# Altium schematic sheet 控制板.SchDoc (part 2 of 2) (continued)
## Nets (continued)
U102-G2: R74.1 U102.G2
U102-G3: R78.2 U102.G3
U102-G4: R432.1 U102.G4
U102-G5: R450.2 U102.G5
U102-G6: R384.2 U101.145(PD3) U102.G6
U102-G11: R517.2 U100.73(PE10) U102.G11
U102-G12: R492.1 U100.88(PH11) U102.G12
U102-G13: R534.1 U100.70(PE9) U102.G13
U102-G14: R516.2 U100.75(PE12) U102.G14
U102-G15: R481.2 U100.110(PG6) U102.G15
U102-G16: R482.2 U100.111(PG7) U102.G16
U102-H1: R73.2 U102.H1
U102-H2: R76.1 U102.H2
U102-H3: R433.1 U102.H3
U102-H4: R434.1 U102.H4
U102-H5: R373.2 U101.163(PB5) U102.H5
U102-H6: R383.1 U101.146(PD4) U102.H6
U102-H11: R493.2 U100.84(PH7) U102.H11
U102-H12: R512.2 U100.78(PE15) U102.H12
U102-H13: R471.2 U100.89(PH12) U102.H13
U102-H14: R507.1 U100.118(PC9) U102.H14
U102-H15: R504.1 U100.115(PC6) U102.H15
U102-H16: R505.1 U100.116(PC7) U102.H16
U102-J1: R72.2 U102.J1
U102-J2: C146.2 R308.2 U102.J2
U102-J4: R378.1 U101.169(PE0) U102.J4
U102-J5: R372.1 U102.J5
U102-J6: R380.1 U101.164(PB6) U102.J6
U102-J11: R160.1 U102.J11
U102-J12: R538.1 U100.69(PE8) U102.J12
U102-J13: R484.1 U102.J13
U102-J14: R487.1 U102.J14
U102-J15: C287.1 R137.2 U102.J15
U102-J16: C286.1 R138.2 U102.J16
U102-K1: R71.2 U102.K1
U102-K2: R420.1 U101.108(PG4) U102.K2
U102-K3: R427.2 U101.111(PG7) U102.K3
U102-K4: C8.1 R35.1 U102.K4
U102-K5: R371.1 U102.K5
U102-K6: R376.2 U101.147(PD5) U102.K6
U102-K11: R470.1 U102.K11
U102-K12: R161.1 U102.K12
U102-K13: R469.1 U102.K13
U102-K14: C305.2 R147.2 U102.K14
U102-K15: C288.1 R136.2 U102.K15
U102-K16: C307.2 R145.2 U102.K16
U102-L1: R418.1 U101.112(PG8) U102.L1
U102-L2: R419.1 U101.110(PG6) U102.L2
U102-L3: R421.1 U101.106(PG2) U102.L3
U102-L4: R428.2 U101.109(PG5) U102.L4
U102-L5: R429.2 U101.107(PG3) U102.L5
U102-L7: C283.2 R116.2 U102.L7
U102-L8: C285.2 R118.2 U102.L8
U102-L9: R515.2 U100.77(PE14) U102.L9
U102-L10: R514.2 U100.74(PE11) U102.L10
U102-L12: C314.2 R157.2 U102.L12
U102-L13: C315.2 R156.2 U102.L13
U102-L14: C306.2 R146.2 U102.L14
U102-L15: C289.1 R135.2 U102.L15
U102-L16: C308.2 R144.2 U102.L16
U102-M1: R70.2 U102.M1
U102-M2: R69.2 U102.M2
U102-M3: C149.2 R318.2 U102.M3
U102-M6: C150.2 R326.1 U102.M6
U102-M7: R393.1 U101.66(PG0) U102.M7
U102-M8: R79.2 U102.M8
U102-M9: R513.2 U100.76(PE13) U102.M9
U102-M10: R475.2 U100.97(PD9) U102.M10
U102-M11: C317.2 R154.2 U102.M11
U102-M14: C316.2 R155.2 U102.M14
U102-M15: C290.1 R134.2 U102.M15
U102-M16: C309.2 R143.2 U102.M16
U102-N1: C261.2 R68.2 U102.N1
U102-N2: R392.1 U101.65(PF15) U102.N2
U102-N3: R527.2 U100.142(PD0) U102.N3
U102-N6: R395.1 U101.75(PE12) U102.N6
U102-N7: R411.2 U101.88(PH11) U102.N7
U102-N8: R530.2 U100.150(PD6) U102.N8
U102-N9: R585.1 U100.165(PB7) U102.N9
U102-N10: R587.2 U100.170(PE1) U102.N10
U102-N14: C318.2 R153.2 U102.N14
U102-N15: C300.2 R133.2 U102.N15
U102-N16: C310.2 R142.2 U102.N16
U102-P1: C262.2 R67.2 U102.P1
U102-P2: R66.2 U102.P2
U102-P4: R394.1 U101.73(PE10) U102.P4
U102-P5: R406.1 U101.83(PH6) U102.P5
U102-P6: C38.1 R124.2 U102.P6
U102-P7: R403.1 U101.77(PE14) U102.P7
U102-P8: R398.2 U101.67(PG1) U102.P8
U102-P9: C320.2 R151.2 U102.P9
U102-P10: R528.1 U100.145(PD3) U102.P10
U102-P11: R579.1 U100.164(PB6) U102.P11
U102-P12: R531.2 U100.151(PD7) U102.P12
U102-P13: R128.2 U102.P13
U102-P15: C301.2 R132.2 U102.P15
U102-P16: C311.2 R141.2 U102.P16
U102-R1: R65.2 U102.R1
U102-R3: R399.2 U101.69(PE8) U102.R3
U102-R4: R410.1 U101.84(PH7) U102.R4
U102-R5: R397.2 U101.64(PF14) U102.R5
U102-R6: R401.1 U101.76(PE13) U102.R6
U102-R7: R402.1 U101.74(PE11) U102.R7
U102-R8: C319.2 R152.2 U102.R8
U102-R9: R586.2 U100.169(PE0) U102.R9
U102-R10: R532.2 U100.152(PG9) U102.R10
U102-R11: R533.2 U100.146(PD4) U102.R11
U102-R12: R127.2 U102.R12
U102-R13: C321.2 R150.2 U102.R13
U102-R14: C303.2 R130.2 U102.R14
U102-R16: C313.2 R139.2 U102.R16
U102-T2: C35.1 R453.2 U102.T2
U102-T3: R400.2 U101.70(PE9) U102.T3
U102-T4: C36.1 R121.2 U102.T4
U102-T5: C37.1 R122.2 U102.T5
U102-T6: R123.2 U102.T6
U102-T7: C312.2 R140.2 U102.T7
U102-T8: R412.2 U101.87(PH10) U102.T8
U102-T9: R159.1 U102.T9
U102-T10: R125.2 U100.163(PB5) U102.T10
U102-T12: R529.2 U100.147(PD5) U102.T12
U102-T13: R526.2 U100.143(PD1) U102.T13
U102-T14: R149.2 U102.T14
U102-T15: C304.2 R129.2 U102.T15
Y7-Y0.: C395.1 R183.1 U7.13(Y0)
NetC1_1: C1.1 R2.1 R4.1
NetC1_2: C1.2 R1.2 R3.2
NetC2_1: C2.1 R8.1 R10.1
NetC2_2: C2.2 R7.2 R9.2
NetC3_1: C3.1 R14.2 R15.2
NetC3_2: C3.2 R17.1 R18.1
NetC4_2: C4.2 R280.1 R281.1 U300.3(IN+)
NetC6_2: C6.2 Q15.1(B) R266.1 R267.1
NetC7_2: C7.2 Q14.1(B) R294.2 R295.2
NetC9_2: C9.2 J6.4 R41.1 R42.1 R43.1 TP1121.1
NetC10_1: C10.1 R37.2 R39.2 R40.2 TP214.1 U50.7(IN+)
NetC16_2: C16.2 C17.1 C18.1 C20.1 LB4.1 U101.39(VDDA)
NetC21_1: C21.1 C22.1 R23.1 U101.31(NRST)
NetC23_2: C23.2 C24.2 C25.2 LB6.2 OSC2.4(VCC)
NetC28_2: C28.2 R345.1 U25.6(SCL)
NetC29_2: C29.2 R344.1 U25.5(SDA)
NetC40_1: C40.1 C41.2 C42.2 LB1.1 OSC1.4(VCC)
NetC51_2: C51.2 C52.1 C53.2 C54.2 LB2.2 U100.39(VDDA)
NetC61_1: C61.1 Q28B.3 R186.2 R188.2 R606.1
NetC62_1: C62.1 D48.3 R192.1 R193.1 R194.1
NetC65_2: C65.2 D61.3 R195.1 R196.1 R197.1
NetC66_1: C66.1 D52.3 R198.1 R199.1 R200.1
NetC67_2: C67.2 D68.3 R189.2 R190.2 R191.2
NetC68_1: C68.1 Q1B.1(B) R19.1 R20.1
NetC100_2: C100.2 C102.1 R250.2 R256.2 R257.1 U306.3(IN+)
NetC105_1: C105.1 R16.2 R17.2
NetC105_2: C105.2 R13.1 R14.1
NetC106_1: C106.1 C107.1 R13.2 TP281.1 U300.6(IN-)
NetC106_2: C106.2 C107.2 R28.2 R632.1 TP319.1 U300.7(OUT)
NetC108_1: C108.1 C109.1 R16.1 TP282.1 U300.5(IN+)
NetC112_1: C112.1 C113.1 R181.2 R365.1 TP317.1 U300.8(OUT)
NetC112_2: C112.2 C113.2 R5.2 TP277.1 U300.9(IN-)
NetC114_1: C114.1 C115.1 R6.1 TP278.1 U300.10(IN+)
NetC117_1: C117.1 C118.1 R11.2 TP280.1 U300.12(IN+)
NetC119_1: C119.1 C120.1 R184.2 R366.2 TP318.1 U300.14(OUT)
NetC119_2: C119.2 C120.2 R12.1 TP279.1 U300.13(IN-)
NetC121_1: C121.1 R4.2 R6.2
NetC121_2: C121.2 R3.1 R5.1
NetC122_1: C122.1 R10.2 R12.2
NetC122_2: C122.2 R9.1 R11.1
NetC123_1: C123.1 NC43.2 R304.2 U12.7(VOUT)
NetC125_1: C125.1 R259.1 R272.2 R274.2 U304.8(OUT)
NetC125_2: C125.2 R274.1 R275.2 U304.9(IN-)
NetC126_1: C126.1 R269.2 R270.1 U304.10(IN+)
NetC128_1: C128.1 R271.1 R272.1 U304.12(IN+)
NetC129_1: C129.1 R286.1 R287.2 U303.9(IN-)
NetC129_2: C129.2 R253.1 R283.2 R286.2 U303.8(OUT)
NetC130_2: C130.2 R278.1 R279.2 U303.10(IN+)
NetC132_2: C132.2 R283.1 R284.1 U303.12(IN+)
NetC134_2: C134.2 C141.2 R288.1 R297.1 R301.2 U303.5(IN+)
NetC136_2: C136.2 R290.1 R291.1 U304.5(IN+)
NetC138_2: C138.2 R292.1 R293.1 U304.3(IN+)
NetC139_1: C139.1 R264.1 R277.1 R290.2 U304.1(OUT)
NetC139_2: C139.2 R276.1 R277.2 U304.2(IN-)
NetC140_1: C140.1 Q13.1(B) R298.2 R299.2
NetC142_1: C142.1 Q2.1(B) R302.2 R303.2
NetC143_2: C143.2 R305.2 R306.2 R307.2 TP213.1 U50.11(IN+)
NetC144_1: C144.1 J6.3 R309.1 R310.1 R311.1 TP1120.1
NetC145_1: C145.1 R312.2 U50.8(IN-)
NetC147_2: C147.2 R313.1 R314.1
NetC148_2: C148.2 R315.1 R320.2
NetC151_2: C151.2 R325.2 U50.4(IN-)
NetC155_2: C155.2 R329.2 U16.3(IN-)
NetC158_2: C158.2 R322.2 U18.3(IN-)
NetC164_1: C164.1 R323.2 U17.3(IN-)
NetC166_1: C166.1 R331.1 R453.1 U16.7(OUT) U17.7(OUT) U18.7(OUT)
NetC172_2: C172.2 C173.2 R333.1 R334.1 TP150.1 U21.2(IN+)
NetC174_2: C174.2 R335.1 U21.3(IN-)
NetC177_2: C177.2 C178.2 R337.1 R338.1 TP151.1 U20.2(IN+)
NetC179_2: C179.2 R339.2 U20.3(IN-)
NetC182_2: C182.2 C183.2 R341.2 R342.2 TP152.1 U19.2(IN+)
NetC184_2: C184.2 R343.1 U19.3(IN-)
NetC197_2: C197.2 U101.125(VCAP_2)
NetC201_1: C201.1 R359.1 U101.33(PC1)
NetC210_2: C210.2 R358.1 U101.32(PC0)
NetC211_2: C211.2 R360.1 U101.34(PC2)
NetC233_1: C233.1 U101.81(VCAP_1)
NetC247_1: C247.1 R456.1 U10.1(~{MR})
NetC248_1: C248.1 R413.1 R414.2 TP8.1 U10.4(PFI)
NetC264_2: C264.2 R120.2 U102.J3
NetC324_1: C324.1 U100.81(VCAP_1)
NetC325_1: C325.1 U100.125(VCAP_2)
NetC329_1: C329.1 C330.1 R553.2 U100.31(NRST)
NetC359_1: C359.1 Q16.1(B) R595.1 R596.1
NetC360_2: C360.2 R576.2 U24.5(SDA)
NetC361_2: C361.2 R563.2 U24.6(SCL)
NetC365_2: C365.2 C367.1 R590.1 R591.1 R592.2 U307.12(IN+)
NetC369_2: C369.2 Q27B.1(B) R593.2 R594.1
NetC373_1: C373.1 R602.2 U2.1(Y4) U2.13(Y0)
NetC374_1: C374.1 R600.1 U2.5(Y5) U2.14(Y1)
NetC375_1: C375.1 R601.1 U2.15(Y2)
NetC376_1: C376.1 R603.2 U2.12(Y3)
NetC381_1: C381.1 Q29B.3 R185.1 R187.2 R607.1
NetC382_1: C382.1 Q11.1(B) R619.1 R620.1
NetC384_1: C384.1 R610.1 R613.1 R614.2 TP1202.1 U203.5(IN+)
NetC385_1: C385.1 C386.2 R611.1 R612.1 TP1203.1 U203.7(IN+)
NetC387_2: C387.2 Q10.1(B) R622.1 R623.1
NetC388_2: C388.2 Q9.1(B) R625.1 R626.1
NetC391_1: C391.1 R179.1 U4.13(Y0)
NetC407_1: C407.1 R635.2 U7.5(Y5)
NetC410_2: C410.2 R644.2 R647.1 U313.10(IN+)
NetC411_2: C411.2 R640.1 R641.1 U313.3(IN+)
NetC412_1: C412.1 R642.2 R643.2 U313.2(IN-)
NetC412_2: C412.2 R185.2 R186.1 R643.1 R644.1 TP1515.1 U313.1(OUT)
NetC413_2: C413.2 R182.2 R645.1
NetC415_2: C415.2 R630.1 R648.1
NetC416_2: C416.2 R183.2 R651.1
NetC417_2: C417.2 R649.2 R654.1 U302.10(IN+)
NetC419_2: C419.2 R650.2 R658.1 U302.12(IN+)
NetC421_1: C421.1 R655.1 R657.2 U302.5(IN+)
NetC422_1: C422.1 R659.1 R663.2 U302.3(IN+)
NetC423_2: C423.2 R629.1 R656.2
NetC424_2: C424.2 R631.1 R662.1
NetC425_1: C425.1 R180.2 R719.2
NetC426_1: C426.1 R655.2 R684.2 R692.2 R756.1 TP1512.1 U321.7(OUT)
NetC426_2: C426.2 R686.2 R692.1 U321.6(IN-)
NetC427_1: C427.1 R191.1 R192.2 R654.2 R693.2 TP1514.1 U321.8(OUT)
NetC427_2: C427.2 R693.1 R694.1 U321.9(IN-)
NetC428_1: C428.1 R687.1 R688.1 U321.5(IN+)
NetC429_2: C429.2 R689.1 R690.1 U321.3(IN+)
NetC430_1: C430.1 R695.1 R696.1 U321.10(IN+)
NetC431_2: C431.2 R697.1 R698.1 U321.12(IN+)
NetC432_1: C432.1 R691.2 R699.1 U321.2(IN-)
NetC432_2: C432.2 R659.2 R668.2 R699.2 R753.2 TP1511.1 U321.1(OUT)
NetC435_1: C435.1 R658.2 R665.1 R700.2 R743.1 TP52.1 U321.14(OUT)
NetC435_2: C435.2 R700.1 R701.1 U321.13(IN-)
NetC436_1: C436.1 R702.2 R703.2 U320.6(IN-)
NetC436_2: C436.2 R703.1 R724.2 R778.2 R801.1 TP1508.1 U320.7(OUT)
NetC437_1: C437.1 R704.2 R705.1 U320.9(IN-)
NetC437_2: C437.2 R197.2 R704.1 R723.2 R777.2 TP1513.1 U320.8(OUT)
NetC438_2: C438.2 R706.2 R707.2 U320.5(IN+)
NetC439_2: C439.2 R713.2 R714.2 U320.10(IN+)
NetC441_1: C441.1 R710.1 R711.1 U320.2(IN-)
NetC441_2: C441.2 R200.2 R711.2 R728.2 R804.2 TP1507.1 U320.1(OUT)
NetC442_2: C442.2 R708.2 R709.2 U320.3(IN+)
NetC443_2: C443.2 R715.2 R716.2 U320.12(IN+)
NetC445_1: C445.1 R712.2 R727.2 R774.1 R794.1 TP1510.1 U320.14(OUT)
NetC445_2: C445.2 R712.1 R717.2 U320.13(IN-)
NetC447_1: C447.1 R718.2 R723.1 U301.10(IN+)
NetC448_1: C448.1 R726.1 R727.1 U301.12(IN+)
NetC449_2: C449.2 R628.1 R729.2
NetC450_1: C450.1 R177.2 R722.2
NetC452_1: C452.1 R724.1 R725.2 U301.5(IN+)
NetC454_1: C454.1 R728.1 R733.1 U301.3(IN+)
NetC455_1: C455.1 R178.2 R732.2
NetC457_2: C457.2 R737.2 R768.1 R769.1 TP505.1 U206.11(IN+)
NetC458_1: C458.1 Q35B.3 R767.1 R778.1 R779.2
NetC459_1: C459.1 R734.2 R771.1 R772.1 TP49.1 U206.9(IN+)
NetC460_2: C460.2 D55.3 R770.2 R773.2 R774.2
NetC461_1: C461.1 Q34B.3 R775.1 R776.1 R777.1
NetC462_1: C462.1 R766.2 R780.1 R782.1 TP47.1 U206.5(IN+)
NetC463_2: C463.2 R763.2 R781.2 R783.2 TP50.1 U206.7(IN+)
NetC464_1: C464.1 C465.1 R664.2 R674.2 TP35.1 U213.9(IN+)
NetC466_1: C466.1 Q30B.3 R665.2 R666.2 R667.2
NetC467_2: C467.2 D65.3 R668.1 R669.1 R670.1
NetC468_1: C468.1 C469.2 R671.2 R675.1 TP36.1 U213.11(IN+)
NetC471_1: C471.1 C473.1 R676.1 R683.2 TP64.1 U213.7(IN+)
NetC472_2: C472.2 C474.2 R677.2 R680.2 TP37.1 U213.5(IN+)
NetC475_2: C475.2 Q31B.3 R678.2 R679.1 R684.1
NetC476_1: C476.1 Q32B.3 R742.2 R743.2 R746.2
NetC478_2: C478.2 R741.1 R744.2 R747.1 TP32.1 U211.5(IN+)
NetC479_1: C479.1 R738.1 R745.1 R748.2 TP33.1 U211.7(IN+)
NetC480_2: C480.2 R749.2 R750.2 R760.2 TP51.1 U211.11(IN+)
NetC481_1: C481.1 D54.3 R751.1 R752.1 R753.1
NetC482_2: C482.2 Q33B.3 R754.2 R755.2 R756.2
NetC483_2: C483.2 R757.2 R761.2 R762.2 TP48.1 U211.9(IN+)
NetC485_1: C485.1 C491.2 R787.2 R793.1 TP59.1 U212.11(IN+)
NetC486_2: C486.2 Q37B.3 R792.1 R794.2 R795.1
NetC487_1: C487.1 C489.1 R791.2 R796.2 TP60.1 U212.5(IN+)
NetC488_2: C488.2 C490.2 R788.2 R797.1 TP61.1 U212.7(IN+)
NetC492_1: C492.1 D60.3 R798.2 R800.2 R801.2
NetC493_2: C493.2 C494.2 R784.2 R799.1 TP58.1 U212.9(IN+)
NetC495_2: C495.2 Q36B.3 R802.1 R803.1 R804.1
NetD3_3: D3.3(C) NC11.2 R59.2 TP26.1
NetD62_1: D62.1 U306.14(OUT)
NetD62_3: D62.3 R258.1 R322.1 R343.2
NetD63_1: D63.1 U306.7(OUT)
NetD63_3: D63.3 R254.1 R329.1 R335.2
NetD64_1: D64.1 U306.8(OUT)
NetD64_3: D64.3 R265.1 R323.1 R339.1
NetD66_2: D66.2 R170.2 TP45.1
NetD67_2: D67.2 R51.1 TP1500.1
NetD69_2: D69.2 R126.1 TP38.1
NetD1500_3: D1500.3(C) R176.1 R555.2
NetD1504_3: D1504.3(C) R558.2 R646.2
NetD1508_3: D1508.3(C) R551.2 R661.2
NetD1510_3: D1510.3(C) R546.1 R652.2
NetD1513_3: D1513.3(C) R552.2 R720.2
NetD1515_3: D1515.3(C) R554.2 R731.2
NetD1534_3: D1534.3(C) R44.1 R365.2
NetD1535_3: D1535.3(C) R47.1 R366.1
NetD1542_3: D1542.3(C) R255.2 R355.2
NetD1543_3: D1543.3(C) R27.2 R38.2
NetD1544_3: D1544.3(C) R24.2 R28.1
NetJ1_6: J1.6 J12.2
NetJ4_1: J4.1 R107.1
NetJ4_2: J4.2 R106.1
NetJ4_3: J4.3 R464.2
NetJ4_4: J4.4 R461.2
NetJ4_13: J4.13 R163.1 TP1125.1
NetJ4_14: J4.14 R162.1 TP1123.1
NetJ4_15: J4.15 R423.1 TP1124.1
NetJ4_16: J4.16 R422.1 TP1122.1
NetJ4_17: J4.17 R171.2
NetJ4_18: J4.18 R113.1
NetJ4_19: J4.19 R465.2
NetJ4_20: J4.20 R114.1
NetJ4_21: J4.21 R466.2
NetJ4_22: J4.22 R119.1 TP6.1
NetJ4_23: J4.23 R116.1
NetJ4_24: J4.24 R115.1
NetJ4_25: J4.25 R118.1 TP4.1
NetJ4_26: J4.26 R117.1
NetJ5_1: J5.1 R90.1 TP12.1
NetJ5_2: J5.2 R442.1
NetJ5_3: J5.3 R91.1
NetJ5_4: J5.4 R443.1 TP17.1
NetJ5_5: J5.5 R92.1
NetJ5_7: J5.7 R93.1 TP9.1
NetJ5_8: J5.8 R445.1
NetJ5_9: J5.9 R95.1
NetJ5_10: J5.10 R446.1
NetJ5_11: J5.11 R97.1
NetJ5_12: J5.12 R447.1 TP13.1
NetJ5_13: J5.13 R98.1
NetJ5_14: J5.14 R448.1
NetJ5_15: J5.15 R99.1 TP10.1
NetJ5_16: J5.16 R449.1
NetJ5_18: J5.18 R100.1
NetJ5_19: J5.19 R101.1
NetJ5_20: J5.20 R459.2
NetJ5_21: J5.21 R102.1
NetJ5_22: J5.22 R460.2 TP7.1
NetJ5_23: J5.23 R103.1
NetJ5_24: J5.24 R462.2
NetJ5_25: J5.25 R105.1 TP5.1
NetJ5_26: J5.26 R463.2
NetJ6_1: J6.1 R433.2
NetJ6_2: J6.2 R432.2 TP40.1
NetJ6_6: J6.6 R64.2 R67.1
NetJ6_7: J6.7 R75.2 TP31.1
NetJ6_8: J6.8 R431.2
NetJ6_9: J6.9 R81.2
NetJ6_10: J6.10 R80.2 TP41.1
NetJ6_11: J6.11 R83.1 TP34.1
NetJ6_12: J6.12 R435.1
NetJ6_13: J6.13 R84.1
NetJ6_14: J6.14 R436.1
NetJ6_15: J6.15 R85.1
NetJ6_16: J6.16 R437.1 TP43.1
NetJ6_19: J6.19 R86.1
NetJ6_20: J6.20 R438.1
NetJ6_21: J6.21 R87.1 TP39.1
NetJ6_22: J6.22 R439.1
NetJ6_23: J6.23 R88.1
NetJ6_24: J6.24 R440.1
NetJ6_25: J6.25 R89.1
NetJ6_26: J6.26 R441.1 TP42.1
NetJ12_3: J12.3 Q12B.3(C) R458.2 TP53.1
NetNC3_1: NC3.1 R580.1 U100.166(BOOT0)
NetNC4_2: NC4.2 U100.161(PB3)
NetNC5_2: NC5.2 R582.1 U100.171(PDR_ON)
NetNC6_1: NC6.1 R540.1 U100.58(PB2)
NetNC7_1: NC7.1 R497.1 U100.85(PH8)
NetNC8_2: NC8.2 R496.1 U100.86(PH9)
NetNC10_1: NC10.1 Q13B.3(C) R468.2 TP25.1
NetNC14_1: NC14.1 U100.138(PA15)
NetNC18_1: NC18.1 NC25.2 U101.134(PI3)
NetNC18_2: NC18.2 U30.5
NetNC19_1: NC19.1 NC24.2 U101.132(PI1)
NetNC19_2: NC19.2 U30.6
NetNC20_1: NC20.1 NC23.2 U101.130(PH15)
NetNC20_2: NC20.2 U30.7
NetNC22_1: NC22.1 NC30.2 U30.1
NetNC26_1: NC26.1 NC27.2 U30.3
NetNC27_1: NC27.1 U101.129(PH14)
NetNC28_1: NC28.1 NC29.1 U101.133(PI2)
NetNC29_2: NC29.2 U30.2
NetNC30_1: NC30.1 U101.131(PI0)
NetNC31_1: NC31.1 R374.2 U101.155(PG12)
NetNC32_1: NC32.1 R375.2 U101.154(PG11)
NetNC33_2: NC33.2 R382.1 U101.152(PG9)
NetNC34_2: NC34.2 R381.1 U101.153(PG10)
NetNC35_1: NC35.1 R390.1 U101.58(PB2)
NetNC39_2: NC39.2 U13.12(IN+)
NetNC40_2: NC40.2 U13.10(IN+)
NetNC41_1: NC41.1 NC42.2 U13.6(IN-)
NetNC41_2: NC41.2 U13.7(OUT)
NetNC43_1: NC43.1 NC61.1 U13.5(IN+)
NetNC44_2: NC44.2 NC45.2 NC46.2 U13.3(IN+)
NetNC47_2: NC47.2 NC48.1 NC49.1 U13.2(IN-)
NetNC49_2: NC49.2 U13.1(OUT)
NetNC51_2: NC51.2 Q38B.3(C) R444.1 TP54.1
NetNC58_2: NC58.2 R369.2 U101.171(PDR_ON)
NetNC62_2: NC62.2 R58.1 U101.166(BOOT0)
NetNC63_1: NC63.1 U101.121(PA10)
NetNC64_2: NC64.2 NC65.1 U101.119(PA8)
NetNC68_1: NC68.1 R53.2 U101.86(PH9)
NetNC69_1: NC69.1 R52.2 U101.85(PH8)
NetOSC1_3: OSC1.3(OUT) R158.2 R159.2
NetOSC2_3: OSC2.3(OUT) R22.2
NetQ1B_3: Q1B.3(C) R256.1
NetQ2_3: Q2.3(C) R301.1
NetQ4B_3: Q4B.3(C) R25.2 R273.1
NetQ7B_3: Q7B.3(C) R285.1 R364.2
NetQ9B_3: Q9B.3(C) R289.1 R368.2
NetQ10B_3: Q10B.3(C) R396.1 R685.2
NetQ14B_3: Q14B.3(C) R544.1 R660.2
NetQ16B_3: Q16B.3(C) R547.1 R653.2
NetQ17B_3: Q17B.3(C) R548.1 R730.2
NetQ18B_3: Q18B.3(C) R549.1 R721.2
NetQ27B_3: Q27B.3(C) R591.2
NetR20_2: R20.2 R74.2
NetR22_1: R22.1 U101.29(PH0)
NetR30_2: R30.2 U101.7(PI8)
NetR31_1: R31.1 R128.1 R521.1
NetR32_1: R32.1 R123.1 R524.1
NetR33_1: R33.1 R127.1 R489.1
NetR34_1: R34.1 R124.1 R491.1
NetR35_2: R35.2 R36.1 R37.1 U50.1(OUT)
NetR38_1: R38.1 R324.2 TP18.1 U303.6(IN-) U303.7(OUT)
NetR43_2: R43.2 U50.6(IN-)
NetR51_2: R51.2 R391.1 U101.63(PF13)
NetR54_2: R54.2 R267.2
NetR57_2: R57.2 R295.1
NetR62_1: R62.1 R519.2
NetR63_1: R63.1 R520.2
NetR63_2: R63.2 R386.2 U101.139(PC10)
NetR65_1: R65.1 R404.2 U101.79(PB10)
NetR66_1: R66.1 R452.1 U101.105(PD15)
NetR68_1: R68.1 R340.1 R341.1 U19.7(OUT)
NetR69_1: R69.1 R405.1 U101.80(PB11)
NetR70_1: R70.1 R426.2 U101.115(PC6)
NetR71_1: R71.1 R451.2 U101.104(PD14)
NetR72_1: R72.1 R409.1 U101.94(PB14)
NetR73_1: R73.1 R408.1 U101.95(PB15)
NetR76_2: R76.2 R302.1
NetR77_1: R77.1 R417.1 U101.116(PC7)
NetR78_1: R78.1 R425.2 U101.117(PC8)
NetR79_1: R79.1 R416.1 U101.118(PC9)
NetR82_2: R82.2 U101.128(PH13)
NetR104_2: R104.2 U102.A13
NetR108_1: R108.1 R109.1 U100.79(PB10)
NetR110_1: R110.1 R111.1 U100.80(PB11)
NetR121_1: R121.1 R332.2 R333.2 U21.7(OUT)
NetR122_1: R122.1 R336.2 R337.2 U20.7(OUT)
NetR126_2: R126.2 U102.T11
NetR129_1: R129.1 R609.1 R613.2 U203.2(OUT)
NetR130_1: R130.1 R673.1 R674.1 U213.14(OUT)
NetR131_1: R131.1 R682.1 R683.1 U213.1(OUT)
NetR132_1: R132.1 R790.1 R791.1 U212.2(OUT)
NetR133_1: R133.1 R738.2 R739.2 U211.1(OUT)
NetR134_1: R134.1 R736.1 R737.1 U206.13(OUT)
NetR135_1: R135.1 R763.1 R764.1 U206.1(OUT)
NetR136_1: R136.1 R765.1 R766.1 U206.2(OUT)
NetR139_1: R139.1 R680.1 R681.1 U213.2(OUT)
NetR140_1: R140.1 R784.1 R785.1 U212.14(OUT)
NetR141_1: R141.1 R757.1 R758.1 U211.14(OUT)
NetR142_1: R142.1 R734.1 R735.1 U206.14(OUT)
NetR149_1: R149.1 R593.1
NetR150_1: R150.1 R608.1 R612.2 U203.1(OUT)
NetR151_1: R151.1 R671.1 R672.1 U213.13(OUT)
NetR152_1: R152.1 R786.1 R787.1 U212.13(OUT)
NetR153_1: R153.1 R788.1 R789.1 U212.1(OUT)
NetR154_1: R154.1 R740.2 R741.2 U211.2(OUT)
NetR155_1: R155.1 R759.1 R760.1 U211.13(OUT)
NetR158_1: R158.1 U100.29(PH0)
NetR160_2: R160.2 R499.1 U100.95(PB15)
NetR161_2: R161.2 R473.2 U100.94(PB14)
NetR169_1: R169.1 R170.1 U100.155(PG12)
NetR172_1: R172.1 R626.2
NetR175_2: R175.2 R620.2
NetR176_2: R176.2 U307.1(OUT) U307.2(IN-)
NetR187_1: R187.1 U203.6(IN-)
NetR188_1: R188.1 U203.4(IN-)
NetR189_1: R189.1 U213.4(IN-)
NetR194_2: R194.2 U211.4(IN-)
NetR195_2: R195.2 U212.4(IN-)
NetR198_2: R198.2 U206.4(IN-)
NetR251_2: R251.2 U306.5(IN+)
NetR252_2: R252.2 R253.2 R254.2 U306.6(IN-)
NetR258_2: R258.2 R259.2 R260.2 U306.13(IN-)
NetR261_2: R261.2 U306.12(IN+)
NetR262_2: R262.2 U306.10(IN+)
NetR263_2: R263.2 R264.2 R265.2 U306.9(IN-)
NetR273_2: R273.2 U304.13(IN-) U304.14(OUT)
NetR282_1: R282.1 U300.1(OUT)
NetR285_2: R285.2 U303.13(IN-) U303.14(OUT)
NetR289_2: R289.2 U304.6(IN-) U304.7(OUT)
NetR299_1: R299.1 R347.2
NetR307_1: R307.1 R308.1 R316.2 U50.13(OUT)
NetR309_2: R309.2 U50.10(IN-)
NetR313_2: R313.2 R319.2 U50.9(IN+)
NetR317_1: R317.1 R318.1 R319.1 U50.14(OUT)
NetR320_1: R320.1 R327.1 U50.5(IN+)
NetR321_1: R321.1 U303.3(IN+)
NetR326_2: R326.2 R327.2 R328.2 U50.2(OUT)
NetR344_2: R344.2 R353.1 U101.16(PF0)
NetR345_2: R345.2 R389.1 U101.17(PF1)
NetR346_1: R346.1 U25.7(~{WC})
NetR346_2: R346.2 R354.1 U101.18(PF2)
NetR352_1: R352.1 U101.9(PC14)
NetR367_1: R367.1 U101.48(BYPASS_REG)
NetR370_2: R370.2 R371.2 U101.168(PB9)
NetR372_2: R372.2 R379.1 U101.167(PB8)
NetR387_1: R387.1 U101.8(PC13)
NetR388_1: R388.1 U101.10(PC15)
NetR407_1: R407.1 R434.2 U101.100(PD12)
NetR430_2: R430.2 R450.1 U101.101(PD13)
NetR455_2: R455.2 U10.6(WDI)
NetR456_2: R456.2 U10.5(~{PFO})
NetR457_2: R457.2 U102.C10
NetR467_1: R467.1 U102.C13
NetR469_2: R469.2 R485.1
NetR470_2: R470.2 R486.1
NetR542_1: R542.1 R543.1 U5.2(REF)
NetR550_2: R550.2 U100.48(BYPASS_REG)
NetR563_1: R563.1 R564.1 U100.17(PF1)
NetR565_1: R565.1 U100.10(PC15)
NetR566_1: R566.1 U100.8(PC13)
NetR573_1: R573.1 R574.1 U100.18(PF2)
NetR573_2: R573.2 U24.7(~{WC})
NetR575_1: R575.1 R576.1 U100.16(PF0)
NetR577_1: R577.1 U100.9(PC14)
NetR578_1: R578.1 U100.7(PI8)
NetR588_1: R588.1 R623.2
NetR589_1: R589.1 R595.2
NetR598_2: R598.2 U307.6(IN-) U307.7(OUT)
NetR599_1: R599.1 U307.8(OUT) U307.9(IN-)
NetR601_2: R601.2 R636.1 R637.2 R638.1
NetR603_1: R603.1 R604.1 R605.1
NetR615_1: R615.1 U203.11(IN+)
NetR616_1: R616.1 U203.10(IN-)
NetR617_1: R617.1 U203.9(IN+)
NetR618_1: R618.1 U203.8(IN-)
NetR639_2: R639.2 U313.5(IN+)
NetR645_2: R645.2 R646.1 U313.8(OUT) U313.9(IN-)
NetR648_2: R648.2 R652.1 U302.8(OUT) U302.9(IN-)
NetR651_2: R651.2 R660.1 U302.13(IN-) U302.14(OUT)
NetR653_1: R653.1 R656.1 U302.6(IN-) U302.7(OUT)
NetR661_1: R661.1 R662.2 U302.1(OUT) U302.2(IN-)
NetR667_1: R667.1 U213.8(IN-)
NetR670_2: R670.2 U213.10(IN-)
NetR678_1: R678.1 U213.6(IN-)
NetR685_1: R685.1 U313.13(IN-) U313.14(OUT)
NetR719_1: R719.1 R720.1 U301.8(OUT) U301.9(IN-)
NetR721_1: R721.1 R722.1 U301.6(IN-) U301.7(OUT)
NetR729_1: R729.1 R730.1 U301.13(IN-) U301.14(OUT)
NetR731_1: R731.1 R732.1 U301.1(OUT) U301.2(IN-)
NetR746_1: R746.1 U211.6(IN-)
NetR751_2: R751.2 U211.10(IN-)
NetR754_1: R754.1 U211.8(IN-)
NetR770_1: R770.1 U206.10(IN-)
NetR775_2: R775.2 U206.8(IN-)
NetR779_1: R779.1 U206.6(IN-)
NetR795_2: R795.2 U212.6(IN-)
NetR798_1: R798.1 U212.10(IN-)
NetR802_2: R802.2 U212.8(IN-)
NetU2_3: U2.3(Z) U313.12(IN+)
NetU4_3: U4.3(Z) U307.5(IN+)
NetU7_3: U7.3(Z) U307.10(IN+)
NetU13_8: U13.8(OUT) U13.9(IN-)
NetU13_13: U13.13(IN-) U13.14(OUT)
NetU303_1: U303.1(OUT) U303.2(IN-)
NetU313_6: U313.6(IN-) U313.7(OUT)

Not connected (* = marked no-connect by the designer): D62 2*; D63 2*; D64 2*; ICT1 1*; ICT2 1*; ICT3 1*; ID1 1*; ID2 1*; ID3 1*; ID4 1*; ID5 1*; ID6 1*; NC59 3*; NC60 3*; OSC1 1(NC)*; OSC2 1(NC)*; U3 1* 2* 3* 5* 6*; U9 1* 2* 3* 5* 6*; U10 8(~{WDO})*; U11 1* 2* 3* 5* 6*; U12 1* 2* 3* 5* 6*; U16 5(B)* 6(SB)*; U17 5(B)* 6(SB)*; U18 5(B)* 6(SB)*; U19 5(B)* 6(SB)*; U20 5(B)* 6(SB)*; U21 5(B)* 6(SB)*; U26 3*; U27 2* 4* 5*; U36 1* 2* 3* 5* 6*; U100 1(PE2)* 2(PE3)* 3(PE4)* 4(PE5)* 5(PE6)* 11(PI9)* 12(PI10)* 13(PI11)* 30(PH1)* 43(PH2)* 44(PH3)* 45(PH4)* 46(PH5)* 59(PF11)* 60(PF12)* 63(PF13)* 67(PG1)* 99(PD11)* 122(PA11)* 128(PH13)* 129(PH14)* 130(PH15)* 141(PC12)* 144(PD2)* 153(PG10)* 154(PG11)* 156(PG13)* 157(PG14)* 160(PG15)* 168(PB9)*; U101 2(PE3)* 11(PI9)* 12(PI10)* 13(PI11)* 30(PH1)* 43(PH2)* 44(PH3)* 45(PH4)* 46(PH5)* 59(PF11)* 60(PF12)* 68(PE7)* 78(PE15)* 92(PB12)* 96(PD8)* 97(PD9)* 98(PD10)* 99(PD11)* 120(PA9)* 141(PC12)* 142(PD0)* 143(PD1)* 150(PD6)* 151(PD7)* 156(PG13)* 157(PG14)* 160(PG15)* 165(PB7)* 170(PE1)* 173(PI4)*; U102 N11*; U203 13(OUT)* 14(OUT)*

## Notes on the sheet
- J7-6
- (near TP15) J7-20
- IPV1
- IPV2
- DCI1
- DCI2
- DCI3
- (near C407) VREFD
- (near C407) VREFE
- (near C391) IPV3
- (near C391) IPV4
- (near C391) IPV5
- (near C391) IPV6
- (near C391) IPV7
- IPV8
- IPV9
- U101+U100-162
- (near NC10) U101+U100-124
- U101+U100-137

## Library data of the parts
C1-C68 C100-C105 C107 C109-C112 C114 C116 C118 C120-C165 C167-C171 C173-C176 C178-C181 C183-C290 C300-C385 C387-C463 C465-C467 C469 C470 C473-C488 C492 C493 C495-C498 = CAP
C106 C108 C113 C115 C117 C119 C166 C172 C177 C182 C386 C464 C468 C471 C472 C489-C491 C494 R1-R200 R250-R804 = R
D3 D1500 D1504 D1506-D1508 D1510 D1513 D1515-D1517 D1522 D1524 D1527 D1529 D1530 D1534-D1537 D1539 D1541-D1544 D1546 Q2B Q3B Q4B Q5B Q6B Q7B Q8B Q9B Q10B Q11B Q12B Q13B Q14B Q15B Q16B Q17B Q18B Q19B Q20B Q21B Q22B Q23B Q24B Q25B Q26B Q38B = BAT54S
D48 D52 D54 D55 D60-D65 D68 Q28B Q29B Q30B Q31B Q32B Q33B Q34B Q35B Q36B Q37B = BAV99
D66 D67 D69 = LED
ICT1-ICT3 ID1-ID6 TP1-TP55 TP58-TP61 TP64 TP150-TP153 TP191 TP204 TP209 TP213 TP214 TP277-TP282 TP294 TP316-TP319 TP500-TP508 TP510-TP517 TP1100-TP1107 TP1120-TP1125 TP1202 TP1203 TP1500 TP1502-TP1518 TP1520-TP1522 = T
J1 = CON10: Connector
J12 = CON3: Connector
LB1 LB2 LB4 LB6 = INUD
NC36 NC48 = NC
OSC1 OSC2 = CRYSTAL4
Q1B Q2 Q9-Q11 Q13-Q16 Q27B = NPN-1B2E3C
U3 = 30
U13 U300-U304 U306 U307 U313 U320 U321 = OPAMP-14: Operational Amplifier
U26 = NC3-3_1
U27 = IC5
U30 = IC8
U50 U203 U206 U211-U213 = LM339M